# EasyEDA Pro project Dart25-有控镖航电系统.eprj, schematic Schematic5

## Sheets
1 BQ40Z50: Board Name: 智能电池管理板; Create Date: 2024-10-13; Page Name: BQ40Z50; Project Name: Dart25-有控镖航电系统; Schematic Name: Schematic5; Update Date: 2024-11-16; Company: 嘉立创EDA; Page Size: A4; Version: V1.0
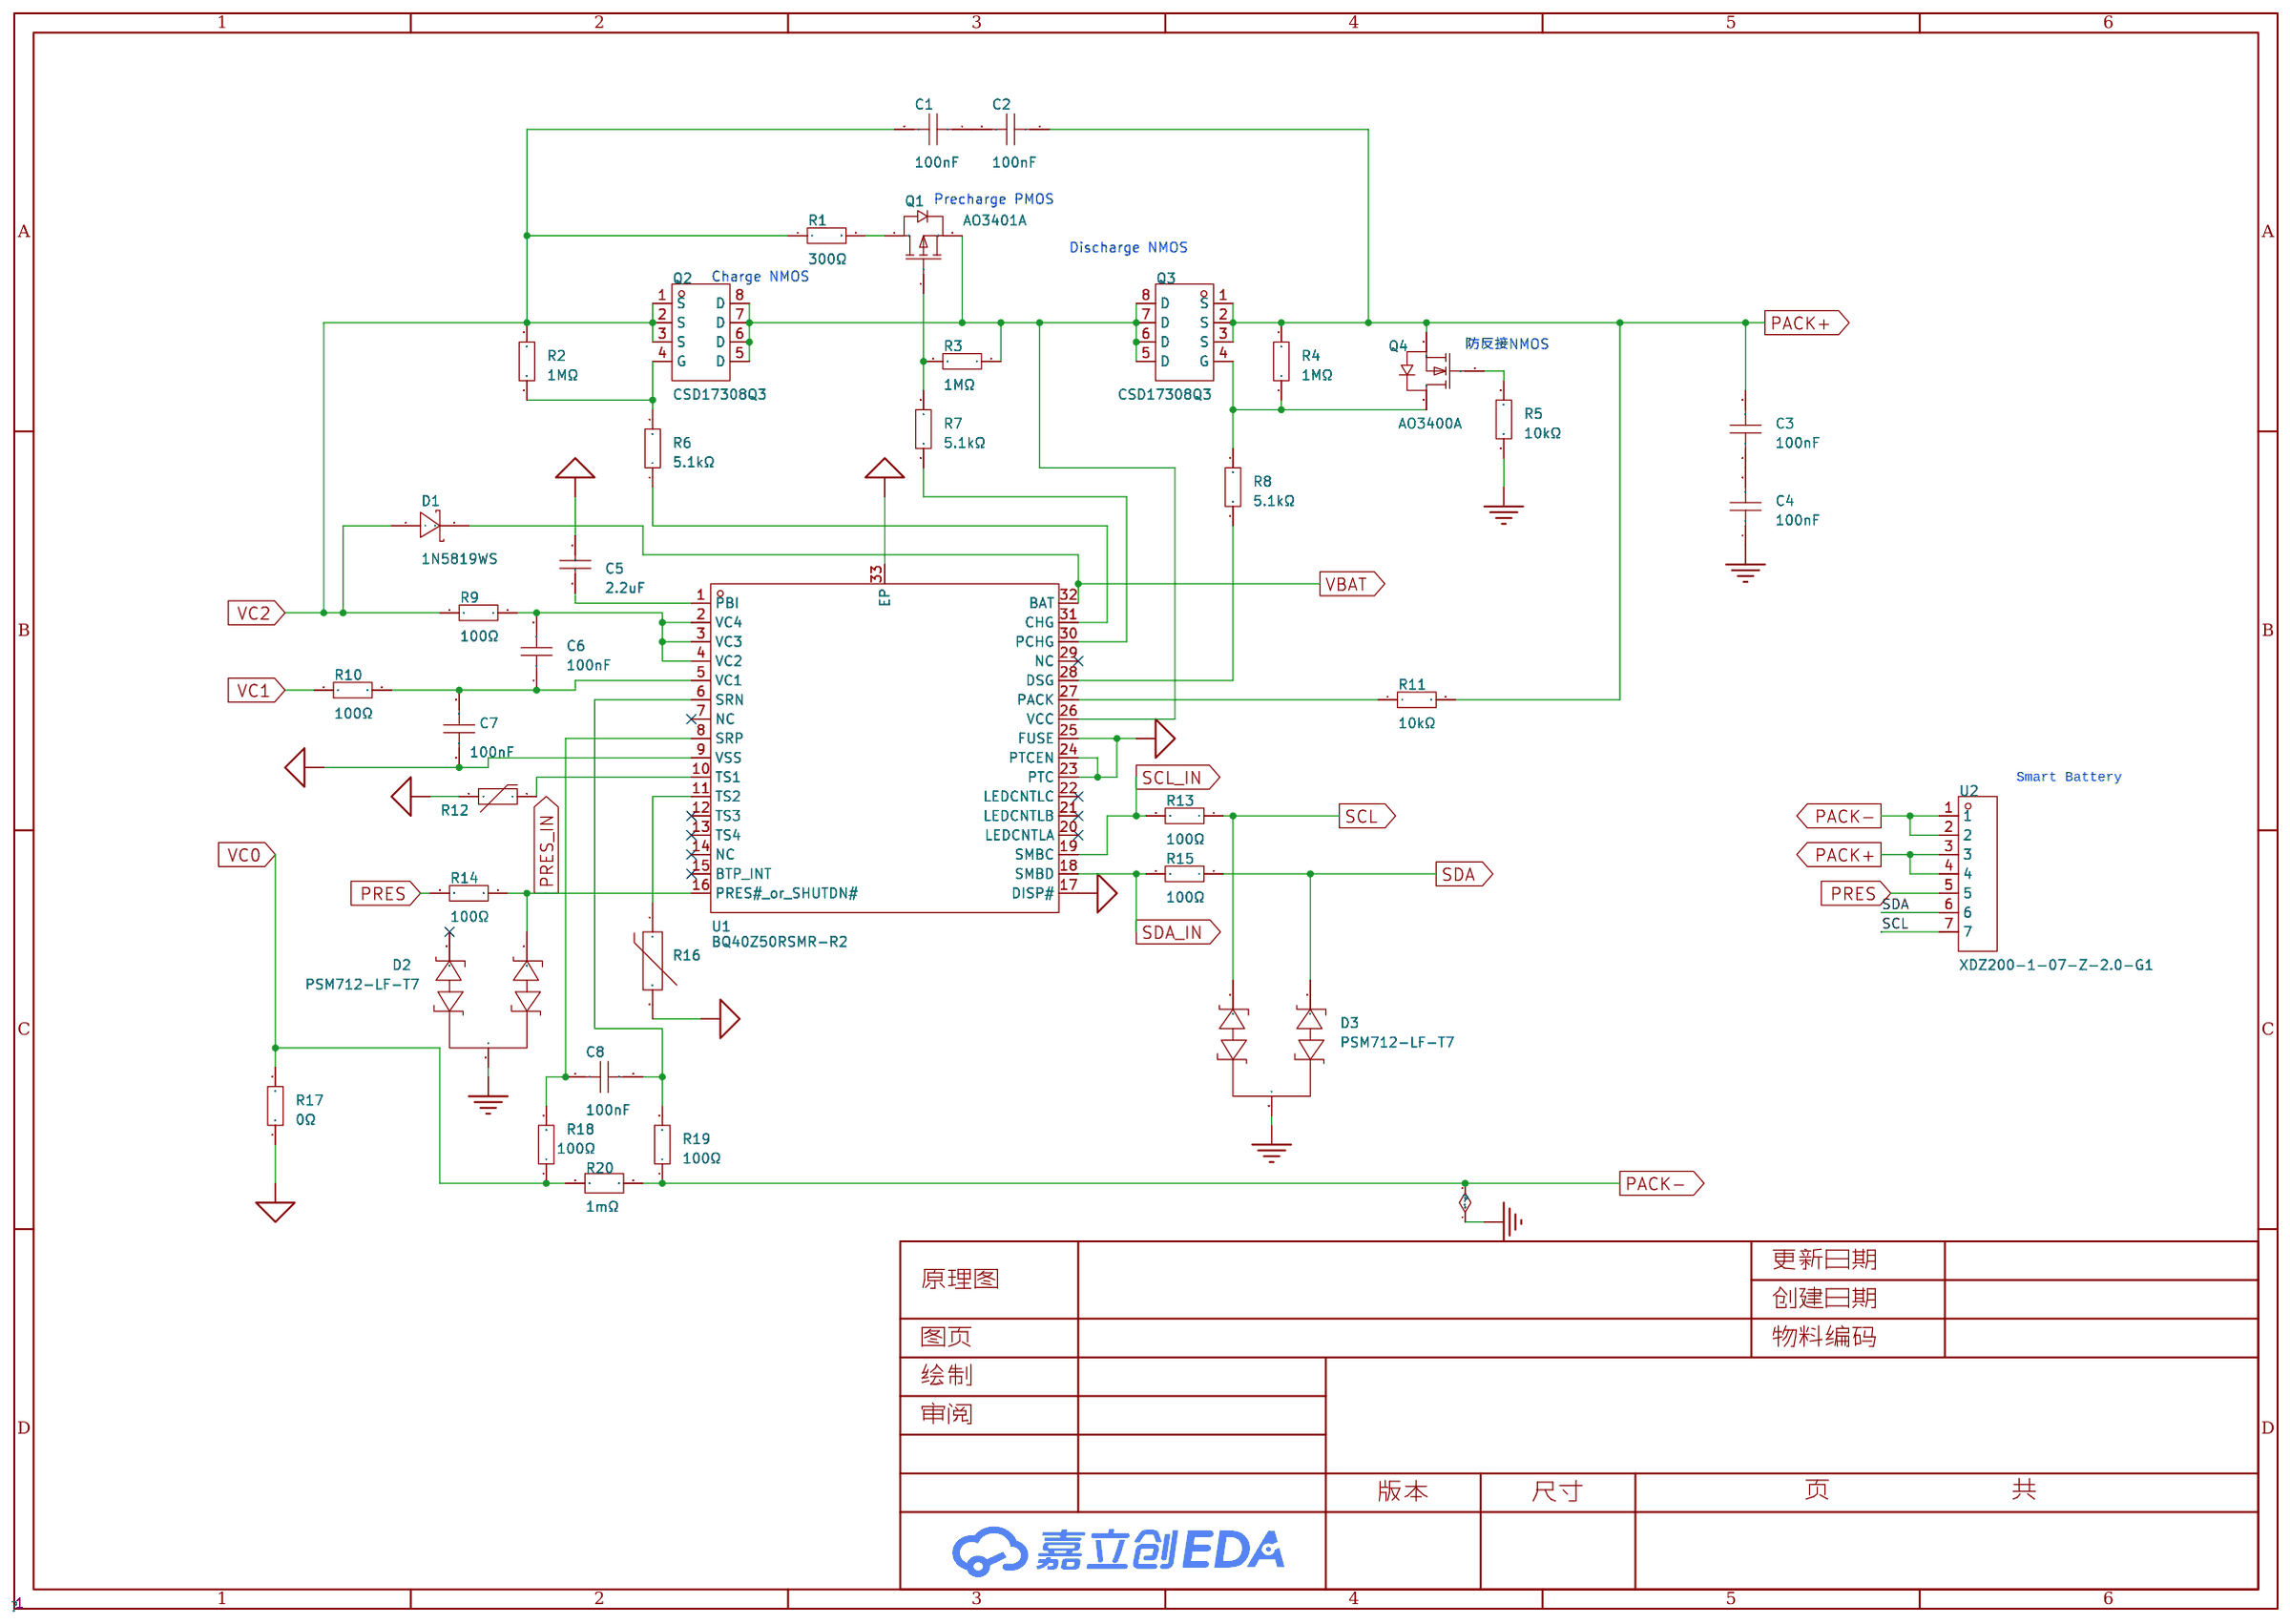
[diagram p2: BQ40Z50]
2 STM32L0: Create Date: 2024-11-16; Page Name: STM32L0; Update Date: 2024-12-03
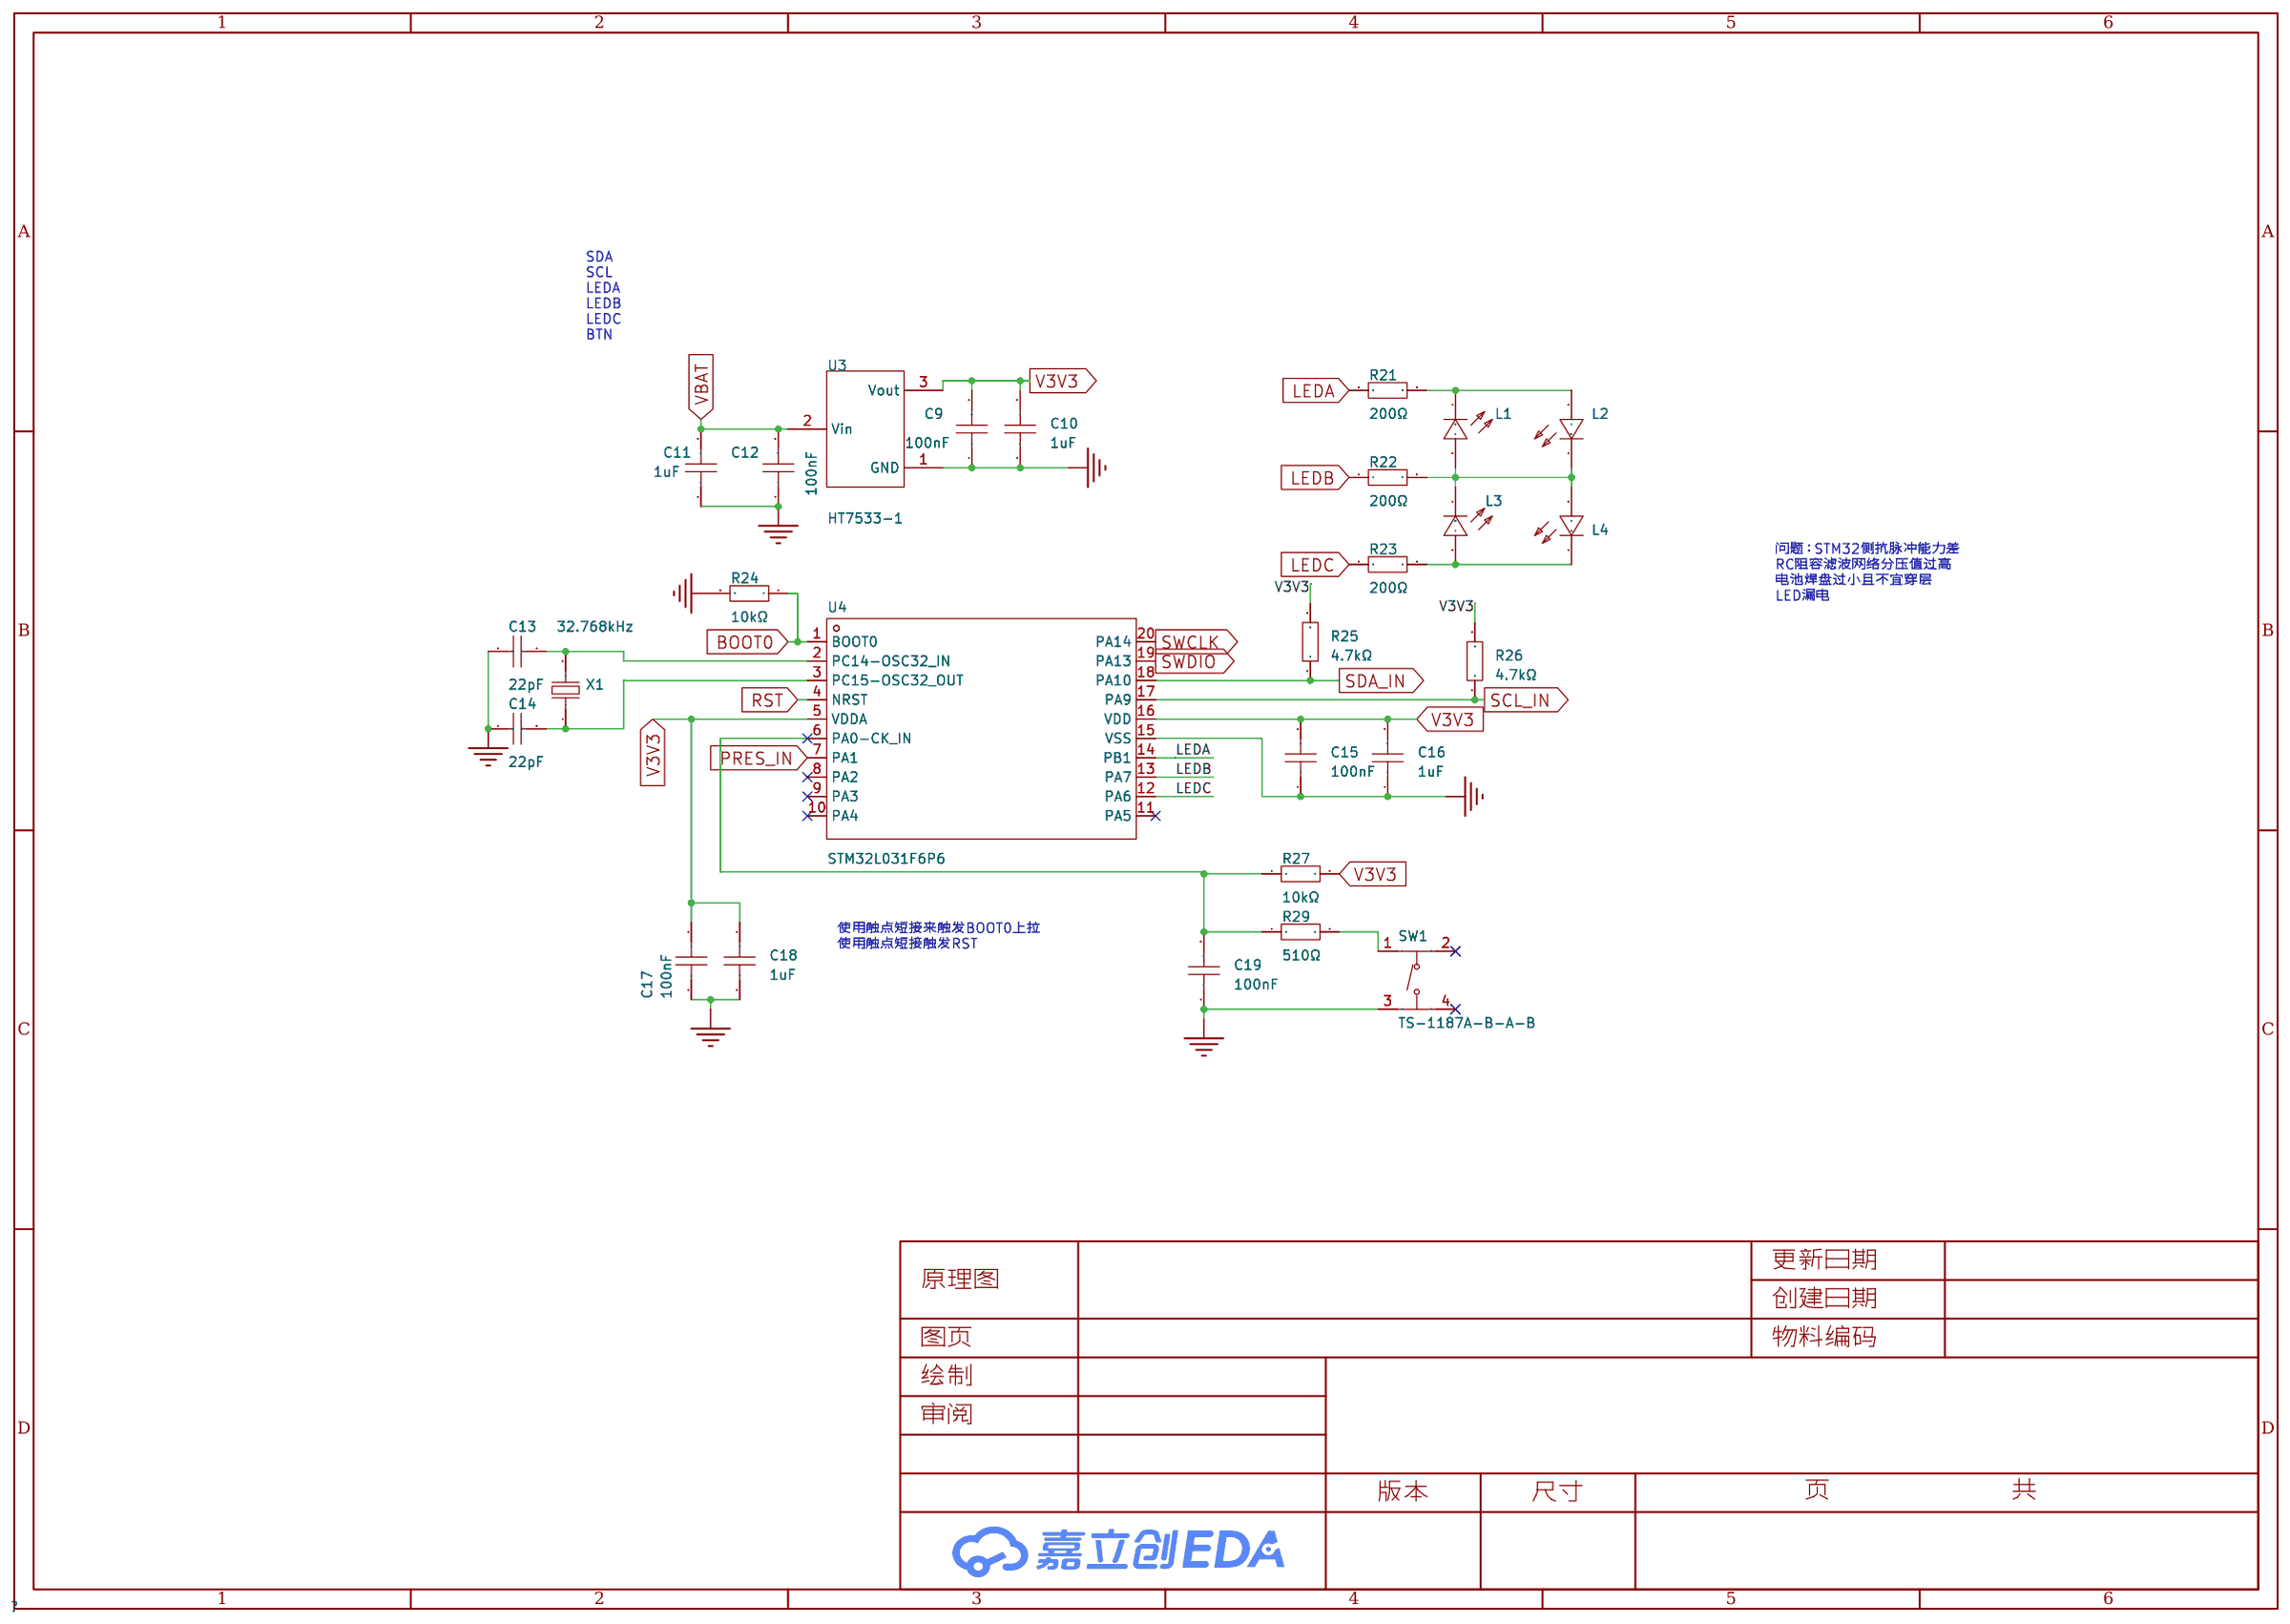
[diagram p3: STM32L0]

## Parts
sheet BQ40Z50
C1  100nF  [C0402]
C2  100nF  [C0402]
C3  100nF  [C0402]
C4  100nF  [C0402]
C5  2.2uF  [C0603]
C6  100nF  [C0402]
C7  100nF  [C0402]
C8  100nF  [C0402]
D1  1N5819WS  [SOD-323_L1.8-W1.3-LS2.5-RD]
D2  PSM712-LF-T7  [SOT-23-3_L3.0-W1.7-P0.95-LS2.9-BR]
D3  PSM712-LF-T7  [SOT-23-3_L3.0-W1.7-P0.95-LS2.9-BR]
Q1  AO3401A  [SOT-23_L2.9-W1.3-P1.90-LS2.4-BR]
Q2  CSD17308Q3  [VSON-CLIP-8_L3.3-W3.3-P0.65-BL]
Q3  CSD17308Q3  [VSON-CLIP-8_L3.3-W3.3-P0.65-BL]
Q4  AO3400A  [SOT-23-3_L2.9-W1.3-P1.90-LS2.4-BR]
R1  300Ω  [R1206]
R2  1MΩ  [R0402]
R3  1MΩ  [R0402]
R4  1MΩ  [R0402]
R5  10kΩ  [R0402]
R6  5.1kΩ  [R0402]
R7  5.1kΩ  [R0402]
R8  5.1kΩ  [R0402]
R9  100Ω  [R0402]
R10  100Ω  [R0402]
R11  10kΩ  [R0402]
R12  NCP18XH103F03RB  [R0603]
R13  100Ω  [R0402]
R14  100Ω  [R0402]
R15  100Ω  [R0402]
R16  MF52A103F3950 (A1)  [RES-TH_L2.5-W2.5-P1.70-D0.3]
R17  0Ω  [R0603]
R18  100Ω  [R0402]
R19  100Ω  [R0402]
R20  1mΩ  [R1206]
U1  BQ40Z50RSMR-R2  [VQFN-32_L4.0-W4.0-P0.40-TL-EP1.4_2]
U2  XDZ200-1-07-Z-2.0-G1  [HDR-TH_7P-P2.00-V-M]
sheet STM32L0
C9  100nF  [C0402]
C10  1uF  [C0402]
C11  1uF  [C0402]
C12  100nF  [C0402]
C13  22pF  [C0402]
C14  22pF  [C0402]
C15  100nF  [C0402]
C16  1uF  [C0402]
C17  100nF  [C0402]
C18  1uF  [C0402]
C19  100nF  [C0402]
L1  19-213/Y2C-CQ2R2L/3T(CY)  [LED0603-RD-YELLOW]
L2  19-213/Y2C-CQ2R2L/3T(CY)  [LED0603-RD-YELLOW]
L3  19-213/Y2C-CQ2R2L/3T(CY)  [LED0603-RD-YELLOW]
L4  19-213/Y2C-CQ2R2L/3T(CY)  [LED0603-RD-YELLOW]
R21  200Ω  [R0402]
R22  200Ω  [R0402]
R23  200Ω  [R0402]
R24  10kΩ  [R0402]
R25  4.7kΩ  [R0402]
R26  4.7kΩ  [R0402]
R27  10kΩ  [R0402]
R29  510Ω  [R0402]
SW1  TS-1187A-B-A-B  [SW-SMD_4P-L5.1-W5.1-P3.70-LS6.5-TL_H1.5]
U3  HT7533-1  [SOT-89-3_L4.5-W2.5-P1.50-LS4.2-BR]
U4  STM32L031F6P6  [TSSOP-20_L6.5-W4.4-P0.65-LS6.4-BL]
X1  32.768kHz  [fc-135r_l3.2-w1.5]

## Library data of the parts
C1-C4 = CL05B104KB54PNC: 容值:100nF;精度:±10%;额定电压:50V;材质(温度系数):X7R;; LCSC Part Name: 100nF ±10% 50V; Supplier Part: C307331; Manufacturer: SAMSUNG(三星); Supplier Footprint: 0402; JLCPCB Part Class: 基础库; Datasheet: https://atta.szlcsc.com/upload/public/pdf/source/20160218/1457707763339.pdf; Supplier: LCSC; Tolerance: ±10%; Voltage Rated: 50V; Temperature Coefficient: X7R
C5 = CL10A225KO8NNNC: 容值:2.2uF;精度:±10%;额定电压:16V;材质(温度系数):X5R;; LCSC Part Name: 2.2uF ±10% 16V; Supplier Part: C23630; Manufacturer: SAMSUNG(三星); Supplier Footprint: 0603; JLCPCB Part Class: 基础库; Datasheet: https://atta.szlcsc.com/upload/public/pdf/source/20160218/1457707763339.pdf; Supplier: LCSC; Tolerance: ±10%; Voltage Rated: 16V; Temperature Coefficient: X5R
C6-C9 C12 C15 C17 C19 = CL05B104KO5NNNC: 容值:100nF;精度:±10%;额定电压:16V;材质(温度系数):X7R;; LCSC Part Name: 100nF ±10% 16V; Supplier Part: C1525; Manufacturer: SAMSUNG(三星); Supplier Footprint: 0402; JLCPCB Part Class: 基础库; Datasheet: https://atta.szlcsc.com/upload/public/pdf/source/20160218/1457707763339.pdf; Supplier: LCSC; Tolerance: ±10%; Voltage Rated: 16V; Temperature Coefficient: X7R
D1 = 1N5819WS_C191023: 正向压降(Vf):600mV@1A;直流反向耐压(Vr):40V;平均整流电流(Io):1A;; LCSC Part Name: 电压:40V 电流:1A; Supplier Part: C191023; Manufacturer: Hottech(合科泰); Supplier Footprint: SOD-323; JLCPCB Part Class: 基础库; Datasheet: https://atta.szlcsc.com/upload/public/pdf/source/20220428/3CB86FD8D28D653594B4E35F9D5AEFD9.pdf; Supplier: LCSC; Forward Voltage (Vf@If): 600mV@1A; Reverse Voltage (Vr): 40V; Average Rectified Current (Io): 1A
D2 D3 = PSM712-LF-T7: 反向截止电压(Vrwm):12V;最大钳位电压:19V;击穿电压:13.3V;; Supplier Part: C32677; Manufacturer: PROTEK; Supplier Footprint: SOT-23; JLCPCB Part Class: 基础库; Datasheet: https://atta.szlcsc.com/upload/public/pdf/source/20140717/1457707154667.pdf; Supplier: LCSC; Reverse Stand-Off Voltage (Vrwm): 12V; Maximum Clamping Voltage: 19V; Breakdown Voltage: 13.3V; Type: TVS
Q1 = AO3401A_C15127: 类型:1个P沟道;漏源电压(Vdss):30V;连续漏极电流(Id):4A;功率(Pd):1.4W;导通电阻(RDS(on)@Vgs,Id):44mΩ@10V,4.3A;阈值电压(Vgs(th)@Id):1.3V@250uA;; LCSC Part Name: 1个P沟道 耐压:30V 电流:4A; Supplier Part: C15127; Manufacturer: AOS; Supplier Footprint: SOT-23; JLCPCB Part Class: 基础库; Datasheet: https://atta.szlcsc.com/upload/public/pdf/source/20160507/1462613609053.pdf; Supplier: LCSC; Type: 1个P沟道; Drain Source Voltage (Vdss): 30V; Continuous Drain Current (Id): 4A; Power Dissipation (Pd): 1.4W; Drain Source On Resistance (RDS(on)@Vgs,Id): 44mΩ@10V,4.3A; Gate Threshold Voltage (Vgs(th)@Id): 1.3V@250uA; Total Gate Charge (Qg@Vgs): 12.2nC@4.5V; Input Capacitance (Ciss@Vds): 1.2nF@15V; Operating Temperature: -55℃~+150℃@(Tj)
Q2 Q3 = CSD17308Q3: 类型:1个N沟道;漏源电压(Vdss):30V;连续漏极电流(Id):14A；44A;功率(Pd):2.7W;导通电阻(RDS(on)@Vgs,Id):10.3mΩ@8V,10A;阈值电压(Vgs(th)@Id):1.8V@250uA;; LCSC Part Name: 1个N沟道 耐压:30V 电流:14A 电流:44A; Supplier Part: C294987; Manufacturer: TI(德州仪器); Supplier Footprint: VSON-CLIP-8(3.3x3.3); JLCPCB Part Class: 扩展库; Datasheet: https://www.ti.com/cn/lit/gpn/csd17308q3; Supplier: LCSC; Type: 1个N沟道; Drain Source Voltage (Vdss): 30V; Continuous Drain Current (Id): 14A；44A; Power Dissipation (Pd): 2.7W; Drain Source On Resistance (RDS(on)@Vgs,Id): 10.3mΩ@8V,10A; Gate Threshold Voltage (Vgs(th)@Id): 1.8V@250uA; Total Gate Charge (Qg@Vgs): 5.1nC@4.5V; Input Capacitance (Ciss@Vds): 700pF@15V; Operating Temperature: -55℃~+150℃@(Tj)
Q4 = AO3400A_C20917: 类型:1个N沟道;漏源电压(Vdss):30V;连续漏极电流(Id):5.7A;功率(Pd):1.4W;导通电阻(RDS(on)@Vgs,Id):26.5mΩ@10V,5.7A;阈值电压(Vgs(th)@Id):1.5V@250uA;; LCSC Part Name: 1个N沟道 耐压:30V 电流:5.7A; Supplier Part: C20917; Manufacturer: AOS; Supplier Footprint: SOT-23-3L; JLCPCB Part Class: 基础库; Datasheet: https://atta.szlcsc.com/upload/public/pdf/source/20140107/1457706668533.pdf; Supplier: LCSC; Type: 1个N沟道; Drain Source Voltage (Vdss): 30V; Continuous Drain Current (Id): 5.7A; Power Dissipation (Pd): 1.4W; Drain Source On Resistance (RDS(on)@Vgs,Id): 26.5mΩ@10V,5.7A; Gate Threshold Voltage (Vgs(th)@Id): 1.5V@250uA; Total Gate Charge (Qg@Vgs): 7nC@4.5V; Input Capacitance (Ciss@Vds): 630pF@15V; Operating Temperature: -55℃~+150℃@(Tj)
R1 = 1206W4F3000T5E: 电阻类型:厚膜电阻;阻值:300Ω;精度:±1%;功率:250mW;最大工作电压:200V;温度系数:±100ppm/℃;; LCSC Part Name: 300Ω ±1% 250mW 厚膜电阻; Supplier Part: C17887; Manufacturer: UNI-ROYAL(厚声); Supplier Footprint: 1206; JLCPCB Part Class: 基础库; Datasheet: https://atta.szlcsc.com/upload/public/pdf/source/20200306/C422600_1E6D84923E4A46A82E41ADD87F860B5C.pdf; Supplier: LCSC; Type: 厚膜电阻; Tolerance: ±1%; Power(Watts): 250mW; Overload Voltage (Max): 200V; Temperature Coefficient: ±100ppm/℃; Operating Temperature Range: -55℃~+155℃
R2-R4 = 0402WGF1004TCE: 电阻类型:厚膜电阻;阻值:1MΩ;精度:±1%;功率:62.5mW;最大工作电压:50V;温度系数:±100ppm/℃;; LCSC Part Name: 1MΩ ±1% 62.5mW 厚膜电阻; Supplier Part: C26083; Manufacturer: UNI-ROYAL(厚声); Supplier Footprint: 0402; JLCPCB Part Class: 基础库; Datasheet: https://atta.szlcsc.com/upload/public/pdf/source/20200306/C422600_1E6D84923E4A46A82E41ADD87F860B5C.pdf; Supplier: LCSC; Type: 厚膜电阻; Tolerance: ±1%; Power(Watts): 62.5mW; Overload Voltage (Max): 50V; Temperature Coefficient: ±100ppm/℃; Operating Temperature Range: -55℃~+155℃
R5 R11 R24 R27 = 0402WGF1002TCE: 电阻类型:厚膜电阻;阻值:10kΩ;精度:±1%;功率:62.5mW;最大工作电压:50V;温度系数:±100ppm/℃;; LCSC Part Name: 10kΩ ±1% 62.5mW 厚膜电阻; Supplier Part: C25744; Manufacturer: UNI-ROYAL(厚声); Supplier Footprint: 0402; JLCPCB Part Class: 基础库; Datasheet: https://atta.szlcsc.com/upload/public/pdf/source/20200306/C422600_1E6D84923E4A46A82E41ADD87F860B5C.pdf; Supplier: LCSC; Type: 厚膜电阻; Tolerance: ±1%; Power(Watts): 62.5mW; Overload Voltage (Max): 50V; Temperature Coefficient: ±100ppm/℃; Operating Temperature Range: -55℃~+155℃
R6-R8 = 0402WGF5101TCE: 电阻类型:厚膜电阻;阻值:5.1kΩ;精度:±1%;功率:62.5mW;最大工作电压:50V;温度系数:±100ppm/℃;; LCSC Part Name: 5.1kΩ ±1% 62.5mW 厚膜电阻; Supplier Part: C25905; Manufacturer: UNI-ROYAL(厚声); Supplier Footprint: 0402; JLCPCB Part Class: 基础库; Datasheet: https://atta.szlcsc.com/upload/public/pdf/source/20200306/C422600_1E6D84923E4A46A82E41ADD87F860B5C.pdf; Supplier: LCSC; Type: 厚膜电阻; Tolerance: ±1%; Power(Watts): 62.5mW; Overload Voltage (Max): 50V; Temperature Coefficient: ±100ppm/℃; Operating Temperature Range: -55℃~+155℃
R9 R10 R13-R15 R18 R19 = 0402WGF1000TCE: 电阻类型:厚膜电阻;阻值:100Ω;精度:±1%;功率:62.5mW;最大工作电压:50V;温度系数:±200ppm/℃;; LCSC Part Name: 100Ω ±1% 62.5mW 厚膜电阻; Supplier Part: C25076; Manufacturer: UNI-ROYAL(厚声); Supplier Footprint: 0402; JLCPCB Part Class: 基础库; Datasheet: https://atta.szlcsc.com/upload/public/pdf/source/20200306/C422600_1E6D84923E4A46A82E41ADD87F860B5C.pdf; Supplier: LCSC; Type: 厚膜电阻; Tolerance: ±1%; Power(Watts): 62.5mW; Overload Voltage (Max): 50V; Temperature Coefficient: ±200ppm/℃; Operating Temperature Range: -55℃~+155℃
R12 = NCP18XH103F03RB: 阻值(25℃):10kΩ;B值(25℃/50℃):3380K;电阻精度:±1%;功率:100mW;B值精度:±1%;最大稳态电流(25℃):310uA;; LCSC Part Name: 10kΩ 电阻精度:±1% 3380K; Supplier Part: C13564; Manufacturer: muRata(村田); Supplier Footprint: 0603; JLCPCB Part Class: 扩展库; Datasheet: https://atta.szlcsc.com/upload/public/pdf/source/20130819/1457706638081.pdf; Supplier: LCSC; Resistance @ 25℃: 10kΩ; B Constant (25℃/50℃): 3380K; Resistance Tolerance: ±1%; B Constant (25℃/85℃): 3434K; B Constant (25℃/100℃): 3455K; Power: 100mW; B Constant Tolerance: ±1%; Steady State Current (Max): 310uA; Operating Temperature: -40℃~+125℃
R16 = MF52A103F3950 (A1): 阻值(25℃):10kΩ;B值(25℃/50℃):3950K;电阻精度:±1%;功率:50mW;B值精度:±1%;最大稳态电流(25℃):-;; LCSC Part Name: 10kΩ 电阻精度:±1% 3950K; Supplier Part: C13879; Manufacturer: 时恒; Supplier Footprint: 插件,P=1.7mm; JLCPCB Part Class: 扩展库; Datasheet: https://atta.szlcsc.com/upload/public/pdf/source/20181018/C324070_6015F64EA824A635FDB9BBFA1E1FD5FE.pdf; Supplier: LCSC; Resistance @ 25℃: 10kΩ; B Constant (25℃/50℃): 3950K; Resistance Tolerance: ±1%; Power: 50mW; B Constant Tolerance: ±1%; Operating Temperature: -55℃~+125℃
R17 = 0603WAF0000T5E: 电阻类型:厚膜电阻;阻值:0Ω;精度:±1%;功率:100mW;最大工作电压:75V;; LCSC Part Name: 0Ω ±1% 100mW 厚膜电阻; Supplier Part: C21189; Manufacturer: UNI-ROYAL(厚声); Supplier Footprint: 0603; JLCPCB Part Class: 基础库; Datasheet: https://atta.szlcsc.com/upload/public/pdf/source/20200306/C422600_1E6D84923E4A46A82E41ADD87F860B5C.pdf; Supplier: LCSC; Type: 厚膜电阻; Tolerance: ±1%; Power(Watts): 100mW; Overload Voltage (Max): 75V; Operating Temperature Range: -55℃~+155℃
R20 = FRM121WFR001TM: 电阻类型:采样电阻;阻值:1mΩ;精度:±1%;额定压降:-;功率:1W;温度系数:±50ppm/℃;安装方式:-;; LCSC Part Name: 1mΩ ±1% 1W; Supplier Part: C7467246; Manufacturer: FOJAN(富捷); Supplier Footprint: 1206; JLCPCB Part Class: 扩展库; Datasheet: https://atta.szlcsc.com/upload/public/pdf/source/20230824/92C230529AE8C6B64A9767C003DF6A1A.pdf; Supplier: LCSC; Type: 采样电阻; Tolerance: ±1%; Power(Watts): 1W; Temperature Coefficient: ±50ppm/℃
U1 = BQ40Z50RSMR-R2: Supplier Part: C2845123; Manufacturer: TI(德州仪器); Supplier Footprint: VQFN-32-EP(4x4); JLCPCB Part Class: 扩展库; Datasheet: https://www.ti.com/cn/lit/gpn/bq40z50-r2; Supplier: LCSC
U2 = XDZ200-1-07-Z-2.0-G1: 插针结构:1x7P;间距:2mm;圆针/方针:方针;安装类型:直插;排数:单排;总PIN位数:7P;额定电流:1.5A;配合针长度:3.9mm;塑高:2mm;端接针长度:2.8mm;触头镀层:金;工作温度范围:-40℃~+105℃;颜色:黑色;; LCSC Part Name: 1x7P 间距:2mm 直插 方针; Supplier Part: C19190943; Manufacturer: XUNDA(讯答); Supplier Footprint: 插件,P=2mm; JLCPCB Part Class: Extended Part; Datasheet: https://atta.szlcsc.com/upload/public/pdf/source/20231109/3E6501A16770CD5922763E41CE42EA59.pdf; Supplier: LCSC; Pin Structure: 1x7P; Pitch: 2mm; Circluar Pins/Square Pins: 方针; Mounting Type: 直插; Number of Rows: 单排; Number of Pins: 7P; Current Rating (Max): 1.5A; Length of Mating Pin: 3.9mm; Insulation Height: 2mm; Length of End Connection Pin: 2.8mm; Contact Plating: 金; Operating Temperature Range: -40℃~+105℃; Color: 黑色
C10 C11 C16 C18 = CL05A105KA5NQNC: 容值:1uF;精度:±10%;额定电压:25V;材质(温度系数):X5R;; LCSC Part Name: 1uF ±10% 25V; Supplier Part: C52923; Manufacturer: SAMSUNG(三星); Supplier Footprint: 0402; JLCPCB Part Class: 基础库; Datasheet: https://atta.szlcsc.com/upload/public/pdf/source/20160218/1457707763339.pdf; Supplier: LCSC; Tolerance: ±10%; Voltage Rated: 25V; Temperature Coefficient: X5R
C13 C14 = 0402CG220J500NT: 容值:22pF;精度:±5%;额定电压:50V;材质(温度系数):C0G;; LCSC Part Name: 22pF ±5% 50V; Supplier Part: C1555; Manufacturer: FH(风华); Supplier Footprint: 0402; JLCPCB Part Class: 基础库; Datasheet: https://atta.szlcsc.com/upload/public/pdf/source/20200305/C486355_26A10D38EF8C2A5C37091D0039909270.pdf; Supplier: LCSC; Tolerance: ±5%; Voltage Rated: 50V; Temperature Coefficient: C0G
L1-L4 = 19-213/Y2C-CQ2R2L/3T(CY): 发光颜色:黄色;功率:60mW;正向电流:20mA;主波长:585.5nm~591.5nm;二极管配置:-;透镜颜色:无色透明透镜;色温:-;发光角度:120°;载带方式:-;工作温度:-40℃~+85℃;; LCSC Part Name: 黄灯; Supplier Part: C72038; Manufacturer: EVERLIGHT(亿光); Supplier Footprint: 0603; JLCPCB Part Class: 基础库; Datasheet: https://atta.szlcsc.com/upload/public/pdf/source/20160507/1462613613586.pdf; Supplier: LCSC; Emitted Color: 黄色; Power Dissipation: 60mW; Forward Current: 20mA; Dominant Wavelength: 585.5nm~591.5nm; Peak Wavelength: 591nm; Lens Color: 无色透明透镜; Viewing Angle: 120°; Operating Temperature: -40℃~+85℃
R21-R23 = 0402WGF2000TCE: LCSC Part Name: 200Ω ±1% 62.5mW 厚膜电阻; Supplier Part: C25087; Manufacturer: UNI-ROYAL(厚声); Supplier Footprint: 0402; JLCPCB Part Class: 基础库; Datasheet: https://atta.szlcsc.com/upload/public/pdf/source/20200306/C422600_1E6D84923E4A46A82E41ADD87F860B5C.pdf; Supplier: LCSC; Type: 厚膜电阻; Tolerance: ±1%; Power(Watts): 62.5mW; Overload Voltage (Max): 50V; Temperature Coefficient: ±100ppm/℃; Operating Temperature Range: -55℃~+155℃
R25 R26 = 0402WGF4701TCE: 电阻类型:厚膜电阻;阻值:4.7kΩ;精度:±1%;功率:62.5mW;最大工作电压:50V;温度系数:±100ppm/℃;; LCSC Part Name: 4.7kΩ ±1% 62.5mW 厚膜电阻; Supplier Part: C25900; Manufacturer: UNI-ROYAL(厚声); Supplier Footprint: 0402; JLCPCB Part Class: 基础库; Datasheet: https://atta.szlcsc.com/upload/public/pdf/source/20200306/C422600_1E6D84923E4A46A82E41ADD87F860B5C.pdf; Supplier: LCSC; Type: 厚膜电阻; Tolerance: ±1%; Power(Watts): 62.5mW; Overload Voltage (Max): 50V; Temperature Coefficient: ±100ppm/℃; Operating Temperature Range: -55℃~+155℃
R29 = 0402WGF5100TCE: LCSC Part Name: 510Ω ±1% 62.5mW 厚膜电阻; Supplier Part: C25123; Manufacturer: UNI-ROYAL(厚声); Supplier Footprint: 0402; JLCPCB Part Class: 基础库; Datasheet: https://atta.szlcsc.com/upload/public/pdf/source/20200306/C422600_1E6D84923E4A46A82E41ADD87F860B5C.pdf; Supplier: LCSC; Type: 厚膜电阻; Tolerance: ±1%; Power(Watts): 62.5mW; Overload Voltage (Max): 50V; Temperature Coefficient: ±100ppm/℃; Operating Temperature Range: -55℃~+155℃
SW1 = TS-1187A-B-A-B: LCSC Part Name: 5.1*5.1*1.5mm 立贴 轻触开关; Supplier Part: C318884; Manufacturer: XKB Connectivity(中国星坤); Supplier Footprint: SMD; JLCPCB Part Class: Basic Part; Datasheet: https://atta.szlcsc.com/upload/public/pdf/source/20200227/C318890_053E50208A88A7BA1965D8746000774E.pdf; Supplier: LCSC; Circuit: 单刀单掷; Actuator Style: 圆形按钮; Operating Force: 160gf; Mounting Style: 立贴; Switch Length: 5.1mm; Switch Width: 5.1mm; Switch Height: 1.5mm; Strike Gundam: 不带; Contact Current: 50mA; Voltage Rating (DC): 12V; Actuator/Cap Color: 金色; With Lamp: 无; Mechanical Life: 10万次; Operating Temperature: -30℃~+85℃
U3 = HT7533-1_C14289: 输出类型:固定;最大输入电压:30V;输出电压:3.3V;最大输出电流:100mA;电源纹波抑制比(PSRR):-;输出极性:正极;; LCSC Part Name: 输入30V 输出3.3V 100mA; Supplier Part: C14289; Manufacturer: HOLTEK(合泰/盛群); Supplier Footprint: SOT-89-3; JLCPCB Part Class: 基础库; Datasheet: https://atta.szlcsc.com/upload/public/pdf/source/20231219/BDECE6E78805324723A3C89E22CB6270.pdf; Supplier: LCSC; Output Type: 固定; Maximum Input Voltage: 30V; Output Voltage: 3.3V; MAX Output Current: 100mA; Dropout Voltage: 55mV@(1mA); Output Polarity: 正极; Number of Outputs: 1
U4 = STM32L031F6P6: CPU内核:-;程序存储容量:32KB;RAM总容量:8KB;GPIO端口数量:15;工作电压范围:1.8V~3.6V;CPU最大主频:32MHz;程序存储器类型:FLASH;; LCSC Part Name: 超低功耗Arm Cortex-M0+ MCU，具有32-KB Flash存储器和32 MHz CPU; Supplier Part: C115208; Manufacturer: ST(意法半导体); Supplier Footprint: TSSOP-20; JLCPCB Part Class: 扩展库; Datasheet: https://atta.szlcsc.com/upload/public/pdf/source/20170818/C115208_1503051154466895131.pdf; Supplier: LCSC; Program Storage Size: 32KB; RAM Size: 8KB; GPIO Ports Number: 15; Operating Voltage Range: 1.8V~3.6V; CPU Maximum Speed: 32MHz; Program Memory Type: FLASH; Operating Temperature Range: -40℃~+85℃; ADC (Bit): 12bit; Peripheral/Function: DMA；PWM; Watchdog: 有; Infrared Data Association: 有; Low-Voltage Detect: 有; Direct Memory Access: 有; Internal Oscillator: 有
X1 = Q13FC13500004_C32346: 晶振类型:贴片晶振;频率:32.768kHz;常温频差:±20ppm;负载电容:12.5pF;; LCSC Part Name: 32.768kHz ±20ppm 12.5pF; Supplier Part: C32346; Manufacturer: EPSON(爱普生); Manufacturer Part: Q13FC13500004; Supplier Footprint: SMD3215-2P; JLCPCB Part Class: Basic Part; Datasheet: https://atta.szlcsc.com/upload/public/pdf/source/20240418/0E0FF5F0356BA3753F616001439D1416.pdf; Supplier: LCSC; Crystal Type: 贴片晶振; Normal temperature Frequency Tolerance: ±20ppm; External load capacitor: 12.5pF; Equivalent Series Resistance (ESR): 70kΩ; Operating Temperature: -40℃~+85℃; Load Capacitor: 12.5pF

## Nets
AGND: C5.2 C7.1 R12.2 R16.2 R17.1 U1.9(VSS) U1.17(DISP#) U1.23(PTC) U1.24(PTCEN) U1.25(FUSE) U1.33(EP)
GND: C4.1 C9.1 C10.1 C11.1 C12.1 C13.1 C14.1 C15.1 C16.1 C17.1 C18.1 C19.1 D2.3(K) D3.3(K) R5.1 R19.1 R20.1 R24.2 SW1.3(C) U2.1 U2.2 U3.1(GND) U4.15(VSS)
V3V3: C9.2 C10.2 C15.2 C16.2 C17.2 C18.2 R25.2 R26.2 R27.2 U3.3(Vout) U4.5(VDDA) U4.16(VDD)
VBAT: C11.2 C12.2 D1.1(K) U1.32(BAT) U3.2(Vin)
BOOT0: R24.1 U4.1(BOOT0)
LEDA: R21.1 U4.14(PB1)
LEDB: R22.1 U4.13(PA7)
LEDC: R23.1 U4.12(PA6)
PACK+: C2.1 C3.2 Q3.1(S) Q3.2(S) Q3.3(S) Q4.2(S) R4.2 R11.2 U2.3 U2.4
PRES: R14.2 U2.5
PRES_IN: D2.1(A1) R14.1 U1.16(PRES#_or_SHUTDN#) U4.7(PA1)
RST: U4.4(NRST)
SCL: D3.2(A1) R13.1 U2.7
SCL_IN: R13.2 R26.1 U1.19(SMBC) U4.17(PA9)
SDA: D3.1(A1) R15.1 U2.6
SDA_IN: R15.2 R25.1 U1.18(SMBD) U4.18(PA10)
SWCLK: U4.20(PA14)
SWDIO: U4.19(PA13)
VC0: R17.2 R18.1 R20.2
VC1: R10.1
VC2: C1.2 D1.2(A) Q2.1(S) Q2.2(S) Q2.3(S) R1.1 R2.2 R9.1
$1N357: C6.2 R9.2 U1.2(VC4) U1.3(VC3) U1.4(VC2)
$1N681: C5.1 U1.1(PBI)
$1N857: C6.1 C7.2 R10.2 U1.5(VC1)
$1N1609: C8.2 R19.2 U1.6(SRN)
$1N2442: Q1.1(G) R3.2 R7.2
$1N2863: Q2.4(G) R2.1 R6.2
$1N2922: Q1.3(D) R1.2
$1N3586: R7.1 U1.30(PCHG)
$1N3592: R6.1 U1.31(CHG)
$1N3598: R8.1 U1.28(DSG)
$1N3944: Q3.4(G) Q4.3(D) R4.1 R8.2
$1N4088: R11.1 U1.27(PACK)
$1N4236: Q4.1(G) R5.2
$1N4603: Q1.2(S) Q2.5(D) Q2.6(D) Q2.7(D) Q2.8(D) Q3.5(D) Q3.6(D) Q3.7(D) Q3.8(D) R3.1 U1.26(VCC)
$1N4763: R12.1 U1.10(TS1)
$1N4946: R16.1 U1.11(TS2)
$1N5004: C8.1 R18.2 U1.8(SRP)
$1N7604: C3.1 C4.2
$1N7746: C1.1 C2.2
$5N1366: L3.2(A) L4.1(C) R23.2
$5N1367: L1.2(A) L2.1(C) L3.1(C) L4.2(A) R22.2
$5N1368: L1.1(C) L2.2(A) R21.2
$5N1385: C13.2 U4.2(PC14-OSC32_IN) X1.2
$5N1386: C14.2 U4.3(PC15-OSC32_OUT) X1.1
$5N1407: R29.2 SW1.1(A)
$5N5286: C19.2 R27.1 R29.1 U4.6(PA0-CK_IN)

Not connected (* = marked no-connect by the designer): D2 2(A1)*; SW1 2(B)* 4(D)*; U1 7(NC)* 12(TS3)* 13(TS4)* 14(NC)* 15(BTP_INT)* 20(LEDCNTLA)* 21(LEDCNTLB)* 22(LEDCNTLC)* 29(NC)*; U4 8(PA2)* 9(PA3)* 10(PA4)* 11(PA5)*

## Notes on the sheets
sheet 1
- Precharge PMOS
- Discharge NMOS
- Charge NMOS
- 防反接NMOS
- Smart Battery
sheet 2
- SDA
  SCL
  LEDA
  LEDB
  LEDC
  BTN
- 问题：STM32侧抗脉冲能力差
  RC阻容滤波网络分压值过高
  电池焊盘过小且不宜穿层
  LED漏电
- 使用触点短接来触发BOOT0上拉
  使用触点短接触发RST
